# EasyEDA Pro project ProProject_IMUSensorNodes202312.epro, board 6_6_拼板20240123（带编号）
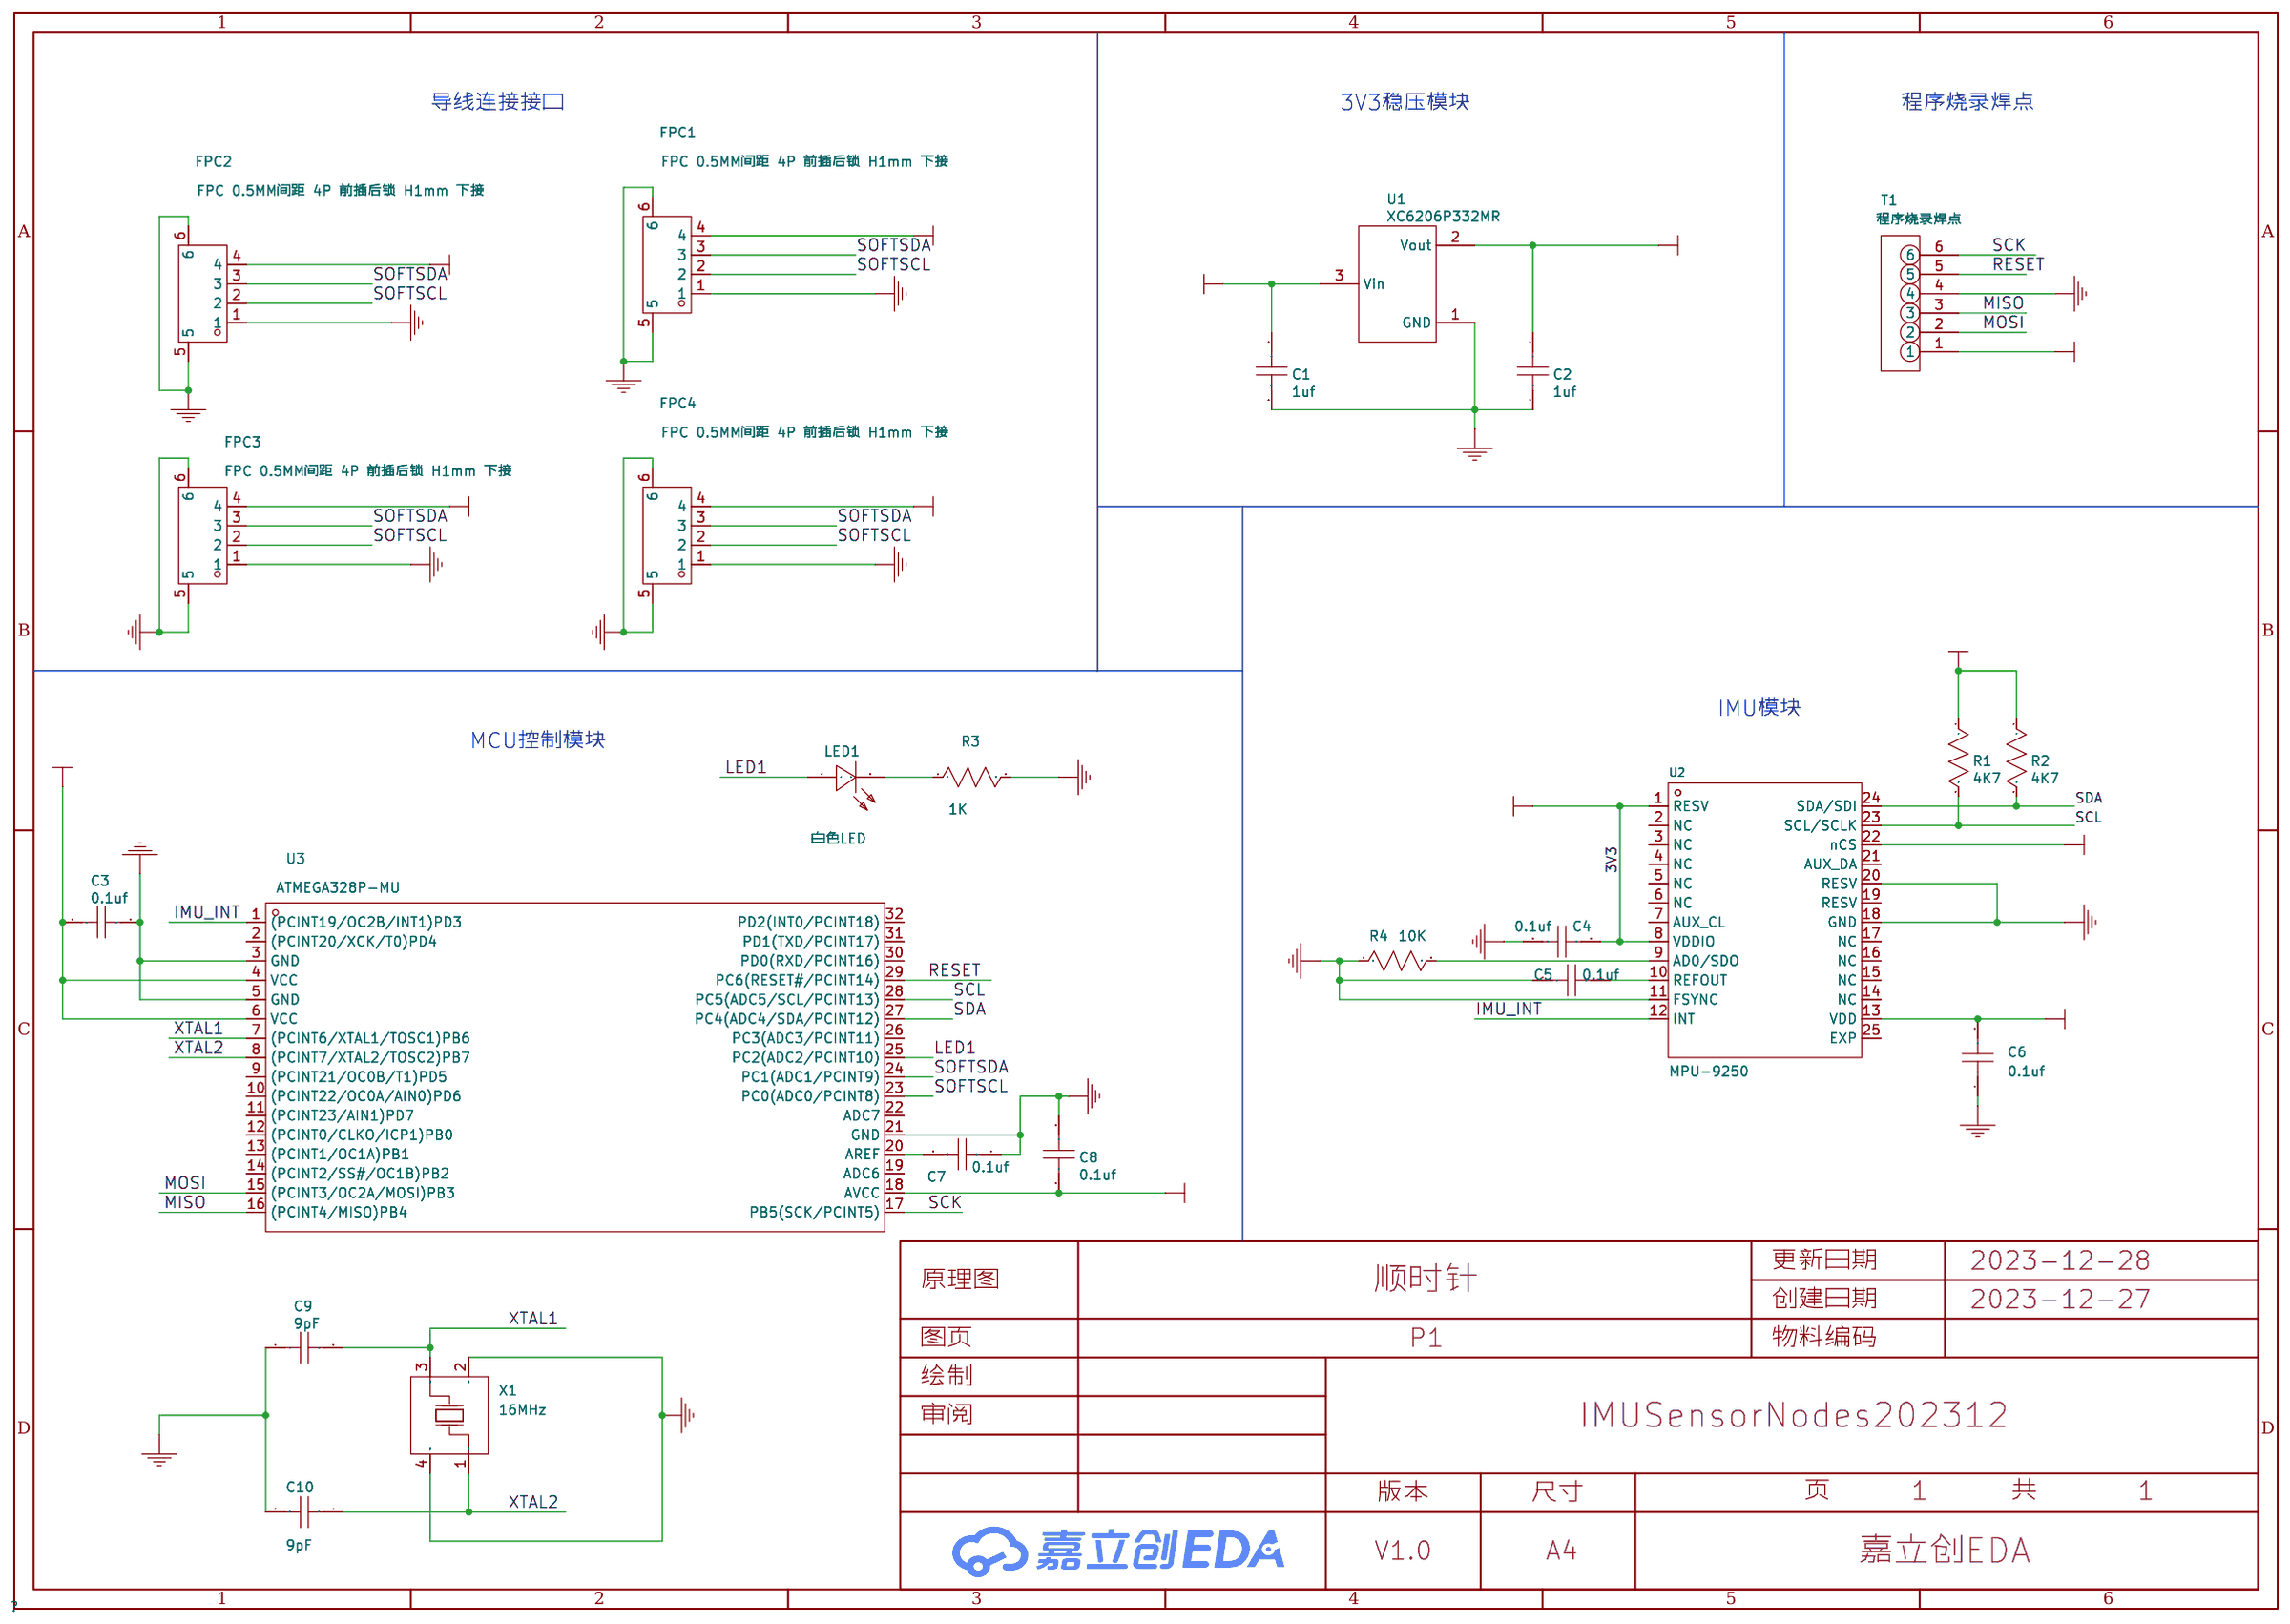
[diagram p0: schematic sheet]

Outline 80.29 x 80.59 mm; copper layers: Top Layer, Bottom Layer. Coordinates in mm from the lower left corner of the outline.
Outline path: 0,78.25 0,70.91 arc(0.68,69.26) 2.33,68.58 9.67,68.58 arc(11.32,69.26) 12,70.91 12,78.25 arc(11.32,79.9) 9.67,80.58 2.33,80.58 arc(0.68,79.9) 0,78.25 ; 0,64.53 0,57.19 arc(0.68,55.55) 2.33,54.86 9.67,54.86 arc(11.32,55.55) 12,57.19 12,64.53 arc(11.32,66.18) 9.67,66.86 2.33,66.86 arc(0.68,66.18) 0,64.53 ; 0,50.82 0,43.48 arc(0.68,41.83) 2.33,41.15 9.67,41.15 arc(11.32,41.83) 12,43.48 12,50.82 arc(11.32,52.46) 9.67,53.15 2.33,53.15 arc(0.68,52.46) 0,50.82 ; 0,37.1 0,29.76 arc(0.68,28.11) 2.33,27.43 9.67,27.43 arc(11.32,28.11) 12,29.76 12,37.1 arc(11.32,38.75) 9.67,39.43 2.33,39.43 arc(0.68,38.75) 0,37.1 ; 0,23.38 0,16.05 arc(0.68,14.4) 2.33,13.72 9.67,13.72 arc(11.32,14.4) 12,16.05 12,23.38 arc(11.32,25.03) 9.67,25.71 2.33,25.71 arc(0.68,25.03) 0,23.38 ; 0,9.67 0,2.33 arc(0.68,0.68) 2.33,0 9.67,0 arc(11.32,0.68) 12,2.33 12,9.67 arc(11.32,11.32) 9.67,12 2.33,12 arc(0.68,11.32) 0,9.67 ; 13.69,78.26 arc(14.37,79.91) 16.02,80.59 23.35,80.59 arc(25,79.91) 25.69,78.26 25.69,70.92 arc(25,69.28) 23.35,68.59 16.01,68.59 16.02,68.59 arc(14.37,69.28) 13.69,70.93 13.69,78.26 ; 13.69,64.55 arc(14.37,66.19) 16.02,66.88 23.35,66.88 arc(25,66.19) 25.69,64.54 25.69,57.21 arc(25,55.56) 23.35,54.88 16.01,54.88 16.02,54.88 arc(14.37,55.56) 13.69,57.21 13.69,64.55 ; 13.69,50.83 arc(14.37,52.48) 16.02,53.16 23.35,53.16 arc(25,52.48) 25.69,50.83 25.69,43.49 arc(25,41.84) 23.35,41.16 16.01,41.16 16.02,41.16 arc(14.37,41.84) 13.69,43.49 13.69,50.83 ; 13.69,37.11 arc(14.37,38.76) 16.02,39.44 23.35,39.44 arc(25,38.76) 25.69,37.11 25.69,29.78 arc(25,28.13) 23.35,27.45 16.01,27.44 16.02,27.45 arc(14.37,28.13) 13.69,29.78 13.69,37.11 ; 13.69,23.4 arc(14.37,25.04) 16.02,25.73 23.35,25.73 arc(25,25.04) 25.69,23.39 25.69,16.06 arc(25,14.41) 23.35,13.73 16.01,13.73 16.02,13.73 arc(14.37,14.41) 13.69,16.06 13.69,23.4 ; 13.69,9.68 arc(14.37,11.33) 16.02,12.01 23.35,12.01 arc(25,11.33) 25.69,9.68 25.69,2.34 arc(25,0.7) 23.35,0.01 16.01,0.01 16.02,0.01 arc(14.37,0.7) 13.69,2.35 13.69,9.68 ; 27.31,78.25 27.31,70.91 arc(27.99,69.26) 29.64,68.58 36.97,68.58 arc(38.62,69.26) 39.31,70.91 39.31,78.25 arc(38.62,79.9) 36.97,80.58 29.64,80.58 arc(27.99,79.9) 27.31,78.25 ; 27.31,64.53 27.31,57.19 arc(27.99,55.55) 29.64,54.86 36.97,54.86 arc(38.62,55.55) 39.31,57.19 39.31,64.53 arc(38.62,66.18) 36.97,66.86 29.64,66.86 arc(27.99,66.18) 27.31,64.53 ; 27.31,50.82 27.31,43.48 arc(27.99,41.83) 29.64,41.15 36.97,41.15 arc(38.62,41.83) 39.31,43.48 39.31,50.82 arc(38.62,52.46) 36.97,53.15 29.64,53.15 arc(27.99,52.46) 27.31,50.82 ; 27.31,37.1 27.31,29.76 arc(27.99,28.11) 29.64,27.43 36.97,27.43 arc(38.62,28.11) 39.31,29.76 39.31,37.1 arc(38.62,38.75) 36.97,39.43 29.64,39.43 arc(27.99,38.75) 27.31,37.1 ; 27.31,23.38 27.31,16.05 arc(27.99,14.4) 29.64,13.72 36.97,13.72 arc(38.62,14.4) 39.31,16.05 39.31,23.38 arc(38.62,25.03) 36.97,25.71 29.64,25.71 arc(27.99,25.03) 27.31,23.38 ; 27.31,9.67 27.31,2.33 arc(27.99,0.68) 29.64,0 36.97,0 arc(38.62,0.68) 39.31,2.33 39.31,9.67 arc(38.62,11.32) 36.97,12 29.64,12 arc(27.99,11.32) 27.31,9.67 ; 40.99,78.26 arc(41.67,79.91) 43.32,80.59 50.66,80.59 arc(52.31,79.91) 52.99,78.26 52.99,70.92 arc(52.31,69.28) 50.66,68.59 43.31,68.59 43.32,68.59 arc(41.67,69.28) 40.99,70.93 40.99,78.26 ; 40.99,64.55 arc(41.67,66.19) 43.32,66.88 50.66,66.88 arc(52.31,66.19) 52.99,64.54 52.99,57.21 arc(52.31,55.56) 50.66,54.88 43.31,54.88 43.32,54.88 arc(41.67,55.56) 40.99,57.21 40.99,64.55 ; 40.99,50.83 arc(41.67,52.48) 43.32,53.16 50.66,53.16 arc(52.31,52.48) 52.99,50.83 52.99,43.49 arc(52.31,41.84) 50.66,41.16 43.31,41.16 43.32,41.16 arc(41.67,41.84) 40.99,43.49 40.99,50.83 ; 40.99,37.11 arc(41.67,38.76) 43.32,39.44 50.66,39.44 arc(52.31,38.76) 52.99,37.11 52.99,29.78 arc(52.31,28.13) 50.66,27.45 43.31,27.44 43.32,27.45 arc(41.67,28.13) 40.99,29.78 40.99,37.11 ; 40.99,23.4 arc(41.67,25.04) 43.32,25.73 50.66,25.73 arc(52.31,25.04) 52.99,23.39 52.99,16.06 arc(52.31,14.41) 50.66,13.73 43.31,13.73 43.32,13.73 arc(41.67,14.41) 40.99,16.06 40.99,23.4 ; 40.99,9.68 arc(41.67,11.33) 43.32,12.01 50.66,12.01 arc(52.31,11.33) 52.99,9.68 52.99,2.34 arc(52.31,0.7) 50.66,0.01 43.31,0.01 43.32,0.01 arc(41.67,0.7) 40.99,2.35 40.99,9.68 ; 54.61,78.25 54.61,70.91 arc(55.29,69.26) 56.94,68.58 64.28,68.58 arc(65.93,69.26) 66.61,70.91 66.61,78.25 arc(65.93,79.9) 64.28,80.58 56.94,80.58 arc(55.29,79.9) 54.61,78.25 ; 54.61,64.53 54.61,57.19 arc(55.29,55.55) 56.94,54.86 64.28,54.86 arc(65.93,55.55) 66.61,57.19 66.61,64.53 arc(65.93,66.18) 64.28,66.86 56.94,66.86 arc(55.29,66.18) 54.61,64.53 ; 54.61,50.82 54.61,43.48 arc(55.29,41.83) 56.94,41.15 64.28,41.15 arc(65.93,41.83) 66.61,43.48 66.61,50.82 arc(65.93,52.46) 64.28,53.15 56.94,53.15 arc(55.29,52.46) 54.61,50.82 ; 54.61,37.1 54.61,29.76 arc(55.29,28.11) 56.94,27.43 64.28,27.43 arc(65.93,28.11) 66.61,29.76 66.61,37.1 arc(65.93,38.75) 64.28,39.43 56.94,39.43 arc(55.29,38.75) 54.61,37.1 ; 54.61,23.38 54.61,16.05 arc(55.29,14.4) 56.94,13.72 64.28,13.72 arc(65.93,14.4) 66.61,16.05 66.61,23.38 arc(65.93,25.03) 64.28,25.71 56.94,25.71 arc(55.29,25.03) 54.61,23.38 ; 54.61,9.67 54.61,2.33 arc(55.29,0.68) 56.94,0 64.28,0 arc(65.93,0.68) 66.61,2.33 66.61,9.67 arc(65.93,11.32) 64.28,12 56.94,12 arc(55.29,11.32) 54.61,9.67 ; 68.3,78.26 arc(68.98,79.91) 70.63,80.59 77.96,80.59 arc(79.61,79.91) 80.29,78.26 80.29,70.92 arc(79.61,69.28) 77.96,68.59 70.62,68.59 70.63,68.59 arc(68.98,69.28) 68.3,70.93 68.3,78.26 ; 68.3,64.55 arc(68.98,66.19) 70.63,66.88 77.96,66.88 arc(79.61,66.19) 80.29,64.54 80.29,57.21 arc(79.61,55.56) 77.96,54.88 70.62,54.88 70.63,54.88 arc(68.98,55.56) 68.3,57.21 68.3,64.55 ; 68.3,50.83 arc(68.98,52.48) 70.63,53.16 77.96,53.16 arc(79.61,52.48) 80.29,50.83 80.29,43.49 arc(79.61,41.84) 77.96,41.16 70.62,41.16 70.63,41.16 arc(68.98,41.84) 68.3,43.49 68.3,50.83 ; 68.3,37.11 arc(68.98,38.76) 70.63,39.44 77.96,39.44 arc(79.61,38.76) 80.29,37.11 80.29,29.78 arc(79.61,28.13) 77.96,27.45 70.62,27.44 70.63,27.45 arc(68.98,28.13) 68.3,29.78 68.3,37.11 ; 68.3,23.4 arc(68.98,25.04) 70.63,25.73 77.96,25.73 arc(79.61,25.04) 80.29,23.39 80.29,16.06 arc(79.61,14.41) 77.96,13.73 70.62,13.73 70.63,13.73 arc(68.98,14.41) 68.3,16.06 68.3,23.4 ; 68.3,9.68 arc(68.98,11.33) 70.63,12.01 77.96,12.01 arc(79.61,11.33) 80.29,9.68 80.29,2.34 arc(79.61,0.7) 77.96,0.01 70.62,0.01 70.63,0.01 arc(68.98,0.7) 68.3,2.35 68.3,9.68
Stack: Top Layer 0.035mm / Dielectric1 1.51mm FR4 er 4.5 / Bottom Layer 0.035mm

## Design rules (mm)
template: 自定义配置
spacing copperThickness1oz (default): track to track 0.102, other pairs 0.152 to 0.3
spacing copperThickness2oz: track to track 0.203, other pairs 0.152 to 0.3
track width copperThickness1oz (default): min 0.127, default 0.254, max 2.54
track width copperThickness2oz: min 0.203, default 0.254, max 2.54
differential pair differentialPair (default): width min 0.127, default 0.254, max 2.54; gap min 0.152, default 0.152
via viaSize (default): diameter min 0.5, default 0.61, max 10; hole min 0.3, default 0.305, max 6.299
net GND uses copperRegion1

## Placement (name value [footprint] x y rotation side)
Designator  -  [fpc-0.5mm-4p-h1.0]  49.82 47.15 90 top
Designator#2  -  [fpc-0.5mm-4p-h1.0#2]  3.2 19.71 270 top
Designator#3  -  [fpc-0.5mm-4p-h1.0#2]  16.92 60.86 270 top
Designator#4  -  [fpc-0.5mm-4p-h1.0#2]  33.31 63.66 180 top
Designator#5  -  [fpc-0.5mm-4p-h1.0]  22.52 6 90 top
Designator#6  -  [fpc-0.5mm-4p-h1.0#2]  74.33 8.8 180 top
Designator#7  -  [fpc-0.5mm-4p-h1.0#3]  19.72 58.06 0 top
Designator#8  -  [fpc-0.5mm-4p-h1.0#3]  47.02 71.78 0 top
Designator#9  -  [fpc-0.5mm-4p-h1.0#2]  57.81 74.58 270 top
Designator#10  -  [fpc-0.5mm-4p-h1.0#3]  19.72 30.63 0 top
Designator#11  -  [fpc-0.5mm-4p-h1.0]  22.52 47.15 90 top
Designator#12  -  [fpc-0.5mm-4p-h1.0#2]  60.61 8.8 180 top
Designator#13  -  [fpc-0.5mm-4p-h1.0]  36.1 19.71 90 top
Designator#14  -  [fpc-0.5mm-4p-h1.0]  77.13 6 90 top
Designator#15  -  [fpc-0.5mm-4p-h1.0#2]  19.72 36.23 180 top
Designator#16  -  [fpc-0.5mm-4p-h1.0#3]  47.02 16.91 0 top
Designator#17  -  [fpc-0.5mm-4p-h1.0#2]  33.31 22.51 180 top
Designator#18  -  [fpc-0.5mm-4p-h1.0#2]  74.33 77.38 180 top
Designator#19  -  [fpc-0.5mm-4p-h1.0#2]  6 58.06 0 top
Designator#20  -  [fpc-0.5mm-4p-h1.0#2]  6 8.8 180 top
Designator#21  -  [邮票孔]  26.68 33.57 0 top
Designator#22  -  [邮票孔]  40.32 33.56 0 top
Designator#23  -  [邮票孔]  53.98 33.57 0 top
Designator#24  -  [邮票孔]  67.64 33.43 0 top
Designator#25  -  [邮票孔]  5.87 26.73 90 top
Designator#26  -  [邮票孔]  74.08 26.73 90 top
Designator#27  -  [邮票孔]  60.4 26.73 90 top
Designator#28  -  [邮票孔]  33.1 26.73 90 top
Designator#29  -  [邮票孔]  19.47 26.73 90 top
Designator#30  -  [邮票孔]  46.78 26.73 90 top
Designator#31  -  [邮票孔]  5.87 67.88 90 top
Designator#32  -  [邮票孔]  19.47 67.88 90 top
Designator#33  -  [邮票孔]  33.1 67.88 90 top
Designator#34  -  [邮票孔]  46.78 67.88 90 top
Designator#35  -  [邮票孔]  60.4 67.88 90 top
Designator#36  -  [邮票孔]  74.08 67.88 90 top
Designator#37  -  [邮票孔]  13.02 19.71 0 top
Designator#38  -  [邮票孔]  26.68 19.85 0 top
Designator#39  -  [邮票孔]  40.32 19.84 0 top
Designator#40  -  [邮票孔]  53.98 19.85 0 top
Designator#41  -  [邮票孔]  67.64 19.71 0 top
Designator#42  -  [邮票孔]  5.87 13.02 90 top
Designator#43  -  [邮票孔]  74.08 13.02 90 top
Designator#44  -  [邮票孔]  60.4 13.02 90 top
Designator#45  -  [邮票孔]  33.1 13.02 90 top
Designator#46  -  [邮票孔]  19.47 13.02 90 top
Designator#47  -  [邮票孔]  46.78 13.02 90 top
Designator#48  -  [邮票孔]  13.02 6 0 top
Designator#49  -  [邮票孔]  13.02 74.58 0 top
Designator#50  -  [邮票孔]  26.68 6.14 0 top
Designator#51  -  [邮票孔]  40.32 6.13 0 top
Designator#52  -  [邮票孔]  53.98 6.14 0 top
Designator#53  -  [邮票孔]  67.64 6 0 top
Designator#54  -  [邮票孔]  53.98 74.72 0 top
Designator#55  -  [邮票孔]  67.64 74.58 0 top
Designator#56  -  [邮票孔]  26.68 74.72 0 top
Designator#57  -  [邮票孔]  40.32 74.71 0 top
Designator#58  -  [邮票孔]  13.02 60.86 0 top
Designator#59  -  [邮票孔]  26.68 61 0 top
Designator#60  -  [邮票孔]  40.32 60.99 0 top
Designator#61  -  [邮票孔]  53.98 61 0 top
Designator#62  -  [邮票孔]  67.64 60.86 0 top
Designator#63  -  [邮票孔]  5.87 54.17 90 top
Designator#64  -  [邮票孔]  74.08 54.17 90 top
Designator#65  -  [邮票孔]  60.4 54.17 90 top
Designator#66  -  [邮票孔]  33.1 54.17 90 top
Designator#67  -  [邮票孔]  19.47 54.17 90 top
Designator#68  -  [邮票孔]  46.78 54.17 90 top
Designator#69  -  [邮票孔]  13.02 47.15 0 top
Designator#70  -  [邮票孔]  26.68 47.29 0 top
Designator#71  -  [邮票孔]  40.32 47.28 0 top
Designator#72  -  [邮票孔]  53.98 47.29 0 top
Designator#73  -  [邮票孔]  67.64 47.15 0 top
Designator#74  -  [邮票孔]  5.87 40.45 90 top
Designator#75  -  [邮票孔]  74.08 40.45 90 top
Designator#76  -  [邮票孔]  60.4 40.45 90 top
Designator#77  -  [邮票孔]  33.1 40.45 90 top
Designator#78  -  [邮票孔]  19.47 40.45 90 top
Designator#79  -  [邮票孔]  46.78 40.45 90 top
Designator#80  -  [邮票孔]  13.02 33.43 0 top
Designator#81  -  [fpc-0.5mm-4p-h1.0#2]  3.2 6 270 top
Designator#82  -  [fpc-0.5mm-4p-h1.0#2]  6 77.38 180 top
Designator#83  -  [fpc-0.5mm-4p-h1.0]  8.8 47.15 90 top
Designator#84  -  [fpc-0.5mm-4p-h1.0]  8.8 19.71 90 top
Designator#85  -  [fpc-0.5mm-4p-h1.0#3]  74.33 44.35 0 top
Designator#86  -  [fpc-0.5mm-4p-h1.0#2]  44.22 6 270 top
Designator#87  -  [fpc-0.5mm-4p-h1.0#2]  57.81 33.43 270 top
Designator#88  -  [fpc-0.5mm-4p-h1.0#3]  74.33 71.78 0 top
Designator#89  -  [fpc-0.5mm-4p-h1.0#2]  60.61 58.06 0 top
Designator#90  -  [fpc-0.5mm-4p-h1.0#2]  60.61 3.2 0 top
Designator#91  -  [fpc-0.5mm-4p-h1.0#2]  6 36.23 180 top
Designator#92  -  [fpc-0.5mm-4p-h1.0#2]  71.53 74.58 270 top
Designator#93  -  [fpc-0.5mm-4p-h1.0#2]  74.33 36.23 180 top
Designator#94  -  [fpc-0.5mm-4p-h1.0#2]  16.92 33.43 270 top
Designator#95  -  [fpc-0.5mm-4p-h1.0]  8.8 33.43 90 top
Designator#96  -  [fpc-0.5mm-4p-h1.0#3]  74.33 30.63 0 top
Designator#97  -  [fpc-0.5mm-4p-h1.0]  63.41 6 90 top
Designator#98  -  [fpc-0.5mm-4p-h1.0#2]  71.53 6 270 top
Designator#99  -  [fpc-0.5mm-4p-h1.0]  22.52 33.43 90 top
Designator#100  -  [fpc-0.5mm-4p-h1.0#2]  3.2 60.86 270 top
Designator#101  -  [fpc-0.5mm-4p-h1.0#3]  19.72 44.35 0 top
Designator#102  -  [fpc-0.5mm-4p-h1.0#2]  6 3.2 0 top
Designator#103  -  [fpc-0.5mm-4p-h1.0]  63.41 33.43 90 top
Designator#104  -  [fpc-0.5mm-4p-h1.0#2]  57.81 6 270 top
Designator#105  -  [fpc-0.5mm-4p-h1.0#3]  19.72 3.2 0 top
Designator#106  -  [fpc-0.5mm-4p-h1.0#2]  57.81 19.71 270 top
Designator#107  -  [fpc-0.5mm-4p-h1.0#3]  47.02 30.63 0 top
Designator#108  -  [fpc-0.5mm-4p-h1.0#2]  60.61 16.91 0 top
Designator#109  -  [fpc-0.5mm-4p-h1.0]  63.41 47.15 90 top
Designator#110  -  [CRYSTAL-SMD_4P-L1.6-W1.2-BL]  64.17 23.91 90 top
Designator#111  -  [CRYSTAL-SMD_4P-L1.6-W1.2-BL]  77.88 23.91 90 top
Designator#112  -  [CRYSTAL-SMD_4P-L1.6-W1.2-BL]  9.56 37.62 90 top
Designator#113  -  [CRYSTAL-SMD_4P-L1.6-W1.2-BL]  23.27 37.62 90 top
Designator#114  -  [CRYSTAL-SMD_4P-L1.6-W1.2-BL]  36.86 37.62 90 top
Designator#115  -  [CRYSTAL-SMD_4P-L1.6-W1.2-BL]  50.58 37.62 90 top
Designator#116  -  [CRYSTAL-SMD_4P-L1.6-W1.2-BL]  64.17 37.62 90 top
Designator#117  -  [CRYSTAL-SMD_4P-L1.6-W1.2-BL]  77.88 37.62 90 top
Designator#118  -  [CRYSTAL-SMD_4P-L1.6-W1.2-BL]  77.88 78.77 90 top
Designator#119  -  [CRYSTAL-SMD_4P-L1.6-W1.2-BL]  9.56 23.91 90 top
Designator#120  -  [CRYSTAL-SMD_4P-L1.6-W1.2-BL]  23.27 23.91 90 top
Designator#121  -  [CRYSTAL-SMD_4P-L1.6-W1.2-BL]  36.86 23.91 90 top
Designator#122  -  [CRYSTAL-SMD_4P-L1.6-W1.2-BL]  50.58 23.91 90 top
Designator#123  -  [CRYSTAL-SMD_4P-L1.6-W1.2-BL]  9.56 10.19 90 top
Designator#124  -  [CRYSTAL-SMD_4P-L1.6-W1.2-BL]  23.27 10.19 90 top
Designator#125  -  [CRYSTAL-SMD_4P-L1.6-W1.2-BL]  36.86 10.19 90 top
Designator#126  -  [CRYSTAL-SMD_4P-L1.6-W1.2-BL]  50.58 10.19 90 top
Designator#127  -  [CRYSTAL-SMD_4P-L1.6-W1.2-BL]  64.17 10.19 90 top
Designator#128  -  [CRYSTAL-SMD_4P-L1.6-W1.2-BL]  77.88 10.19 90 top
Designator#129  -  [CRYSTAL-SMD_4P-L1.6-W1.2-BL]  9.56 78.77 90 top
Designator#130  -  [CRYSTAL-SMD_4P-L1.6-W1.2-BL]  64.17 78.77 90 top
Designator#131  -  [CRYSTAL-SMD_4P-L1.6-W1.2-BL]  23.27 78.77 90 top
Designator#132  -  [CRYSTAL-SMD_4P-L1.6-W1.2-BL]  36.86 78.77 90 top
Designator#133  -  [CRYSTAL-SMD_4P-L1.6-W1.2-BL]  50.58 78.77 90 top
Designator#134  -  [CRYSTAL-SMD_4P-L1.6-W1.2-BL]  9.56 65.05 90 top
Designator#135  -  [CRYSTAL-SMD_4P-L1.6-W1.2-BL]  23.27 65.05 90 top
Designator#136  -  [CRYSTAL-SMD_4P-L1.6-W1.2-BL]  36.86 65.05 90 top
Designator#137  -  [CRYSTAL-SMD_4P-L1.6-W1.2-BL]  50.58 65.05 90 top
Designator#138  -  [CRYSTAL-SMD_4P-L1.6-W1.2-BL]  64.17 65.05 90 top
Designator#139  -  [CRYSTAL-SMD_4P-L1.6-W1.2-BL]  77.88 65.05 90 top
Designator#140  -  [CRYSTAL-SMD_4P-L1.6-W1.2-BL]  9.56 51.34 90 top
Designator#141  -  [CRYSTAL-SMD_4P-L1.6-W1.2-BL]  23.27 51.34 90 top
Designator#142  -  [CRYSTAL-SMD_4P-L1.6-W1.2-BL]  36.86 51.34 90 top
Designator#143  -  [CRYSTAL-SMD_4P-L1.6-W1.2-BL]  50.58 51.34 90 top
Designator#144  -  [CRYSTAL-SMD_4P-L1.6-W1.2-BL]  64.17 51.34 90 top
Designator#145  -  [CRYSTAL-SMD_4P-L1.6-W1.2-BL]  77.88 51.34 90 top
Designator#146  -  [fpc-0.5mm-4p-h1.0]  36.1 47.15 90 top
Designator#147  -  [fpc-0.5mm-4p-h1.0#2]  60.61 36.23 180 top
Designator#148  -  [fpc-0.5mm-4p-h1.0]  49.82 19.71 90 top
Designator#149  -  [fpc-0.5mm-4p-h1.0#2]  33.31 3.2 0 top
Designator#150  -  [fpc-0.5mm-4p-h1.0#2]  71.53 33.43 270 top
Designator#151  -  [fpc-0.5mm-4p-h1.0]  22.52 74.58 90 top
Designator#152  -  [fpc-0.5mm-4p-h1.0#2]  6 63.66 180 top
Designator#153  -  [fpc-0.5mm-4p-h1.0#2]  33.31 71.78 0 top
Designator#154  -  [fpc-0.5mm-4p-h1.0#2]  60.61 44.35 0 top
Designator#155  -  [fpc-0.5mm-4p-h1.0]  8.8 60.86 90 top
Designator#156  -  [fpc-0.5mm-4p-h1.0#2]  16.92 6 270 top
Designator#157  -  [fpc-0.5mm-4p-h1.0]  77.13 19.71 90 top
Designator#158  -  [fpc-0.5mm-4p-h1.0#2]  30.5 33.43 270 top
Designator#159  -  [fpc-0.5mm-4p-h1.0]  49.82 6 90 top
Designator#160  -  [fpc-0.5mm-4p-h1.0]  36.1 33.43 90 top
Designator#161  -  [fpc-0.5mm-4p-h1.0#3]  19.72 16.91 0 top
Designator#162  -  [fpc-0.5mm-4p-h1.0#2]  60.61 77.38 180 top
Designator#163  -  [fpc-0.5mm-4p-h1.0#3]  47.02 3.2 0 top
Designator#164  -  [fpc-0.5mm-4p-h1.0#2]  57.81 47.15 270 top
Designator#165  -  [fpc-0.5mm-4p-h1.0]  63.41 74.58 90 top
Designator#166  -  [fpc-0.5mm-4p-h1.0]  49.82 74.58 90 top
Designator#167  -  [fpc-0.5mm-4p-h1.0#2]  30.5 60.86 270 top
Designator#168  -  [fpc-0.5mm-4p-h1.0#2]  30.5 6 270 top
Designator#169  -  [fpc-0.5mm-4p-h1.0]  22.52 19.71 90 top
Designator#170  -  [fpc-0.5mm-4p-h1.0]  63.41 19.71 90 top
Designator#171  -  [fpc-0.5mm-4p-h1.0]  36.1 60.86 90 top
Designator#172  -  [fpc-0.5mm-4p-h1.0#2]  6 16.91 0 top
Designator#173  -  [fpc-0.5mm-4p-h1.0#2]  30.5 47.15 270 top
Designator#174  -  [fpc-0.5mm-4p-h1.0#2]  33.31 16.91 0 top
Designator#175  -  [fpc-0.5mm-4p-h1.0]  49.82 33.43 90 top
Designator#176  -  [fpc-0.5mm-4p-h1.0#2]  60.61 63.66 180 top
Designator#177  -  [fpc-0.5mm-4p-h1.0#2]  6 71.78 0 top
Designator#178  -  [R0201]  14.51 30.38 270 top
Designator#179  -  [R0201]  28.1 30.38 270 top
Designator#180  -  [R0201]  41.81 30.38 270 top
Designator#181  -  [R0201]  55.4 30.38 270 top
Designator#182  -  [R0201]  69.12 30.38 270 top
Designator#183  -  [R0201]  69.12 71.53 270 top
Designator#184  -  [R0201]  0.79 16.67 270 top
Designator#185  -  [R0201]  14.51 16.67 270 top
Designator#186  -  [R0201]  28.1 16.67 270 top
Designator#187  -  [R0201]  41.81 16.67 270 top
Designator#188  -  [R0201]  55.4 16.67 270 top
Designator#189  -  [R0201]  69.12 16.67 270 top
Designator#190  -  [R0201]  0.79 2.95 270 top
Designator#191  -  [R0201]  14.51 2.95 270 top
Designator#192  -  [R0201]  28.1 2.95 270 top
Designator#193  -  [R0201]  41.81 2.95 270 top
Designator#194  -  [R0201]  55.4 2.95 270 top
Designator#195  -  [R0201]  69.12 2.95 270 top
Designator#196  -  [R0201]  0.79 71.53 270 top
Designator#197  -  [R0201]  55.4 71.53 270 top
Designator#198  -  [R0201]  14.51 71.53 270 top
Designator#199  -  [R0201]  28.1 71.53 270 top
Designator#200  -  [R0201]  41.81 71.53 270 top
Designator#201  -  [R0201]  0.79 57.81 270 top
Designator#202  -  [R0201]  14.51 57.81 270 top
Designator#203  -  [R0201]  28.1 57.81 270 top
Designator#204  -  [R0201]  41.81 57.81 270 top
Designator#205  -  [R0201]  55.4 57.81 270 top
Designator#206  -  [R0201]  69.12 57.81 270 top
Designator#207  -  [R0201]  0.79 44.1 270 top
Designator#208  -  [R0201]  14.51 44.1 270 top
Designator#209  -  [R0201]  28.1 44.1 270 top
Designator#210  -  [R0201]  41.81 44.1 270 top
Designator#211  -  [R0201]  55.4 44.1 270 top
Designator#212  -  [R0201]  69.12 44.1 270 top
Designator#213  -  [R0201]  0.79 30.38 270 top
Designator#214  -  [fpc-0.5mm-4p-h1.0#2]  19.72 49.95 180 top
Designator#215  -  [fpc-0.5mm-4p-h1.0]  77.13 47.15 90 top
Designator#216  -  [fpc-0.5mm-4p-h1.0#2]  60.61 30.63 0 top
Designator#217  -  [fpc-0.5mm-4p-h1.0#2]  71.53 19.71 270 top
Designator#218  -  [fpc-0.5mm-4p-h1.0#2]  47.02 36.23 180 top
Designator#219  -  [fpc-0.5mm-4p-h1.0#2]  44.22 33.43 270 top
Designator#220  -  [fpc-0.5mm-4p-h1.0#2]  30.5 74.58 270 top
Designator#221  -  [fpc-0.5mm-4p-h1.0#2]  47.02 22.51 180 top
Designator#222  -  [fpc-0.5mm-4p-h1.0#3]  74.33 16.91 0 top
Designator#223  -  [fpc-0.5mm-4p-h1.0#3]  74.33 3.2 0 top
Designator#224  -  [fpc-0.5mm-4p-h1.0#3]  47.02 44.35 0 top
Designator#225  -  [fpc-0.5mm-4p-h1.0#2]  19.72 63.66 180 top
Designator#226  -  [fpc-0.5mm-4p-h1.0#2]  33.31 36.23 180 top
Designator#227  -  [fpc-0.5mm-4p-h1.0#2]  60.61 71.78 0 top
Designator#228  -  [fpc-0.5mm-4p-h1.0#2]  6 49.95 180 top
Designator#229  -  [fpc-0.5mm-4p-h1.0#2]  3.2 33.43 270 top
Designator#230  -  [fpc-0.5mm-4p-h1.0#2]  47.02 49.95 180 top
Designator#231  -  [fpc-0.5mm-4p-h1.0#2]  47.02 8.8 180 top
Designator#232  -  [fpc-0.5mm-4p-h1.0]  8.8 74.58 90 top
Designator#233  -  [fpc-0.5mm-4p-h1.0#2]  44.22 47.15 270 top
Designator#234  -  [fpc-0.5mm-4p-h1.0#2]  44.22 60.86 270 top
Designator#235  -  [fpc-0.5mm-4p-h1.0#2]  60.61 22.51 180 top
Designator#236  -  [fpc-0.5mm-4p-h1.0#3]  74.33 58.06 0 top
Designator#237  -  [fpc-0.5mm-4p-h1.0#2]  71.53 60.86 270 top
Designator#238  -  [fpc-0.5mm-4p-h1.0#2]  74.33 22.51 180 top
Designator#239  -  [fpc-0.5mm-4p-h1.0#2]  74.33 63.66 180 top
Designator#240  -  [fpc-0.5mm-4p-h1.0#3]  47.02 58.06 0 top
Designator#241  -  [fpc-0.5mm-4p-h1.0#2]  57.81 60.86 270 top
Designator#242  -  [fpc-0.5mm-4p-h1.0#2]  6 30.63 0 top
Designator#243  -  [fpc-0.5mm-4p-h1.0]  77.13 33.43 90 top
Designator#244  -  [fpc-0.5mm-4p-h1.0]  36.1 6 90 top
Designator#245  -  [fpc-0.5mm-4p-h1.0#2]  33.31 30.63 0 top
Designator#246  -  [LED0402]  15.4 30.25 90 top
Designator#247  -  [LED0402]  28.99 30.25 90 top
Designator#248  -  [LED0402]  42.7 30.25 90 top
Designator#249  -  [LED0402]  56.29 30.25 90 top
Designator#250  -  [LED0402]  70.01 30.25 90 top
Designator#251  -  [LED0402]  70.01 71.4 90 top
Designator#252  -  [LED0402]  1.68 16.54 90 top
Designator#253  -  [LED0402]  15.4 16.54 90 top
Designator#254  -  [LED0402]  28.99 16.54 90 top
Designator#255  -  [LED0402]  42.7 16.54 90 top
Designator#256  -  [LED0402]  56.29 16.54 90 top
Designator#257  -  [LED0402]  70.01 16.54 90 top
Designator#258  -  [LED0402]  1.68 2.82 90 top
Designator#259  -  [LED0402]  15.4 2.82 90 top
Designator#260  -  [LED0402]  28.99 2.82 90 top
Designator#261  -  [LED0402]  42.7 2.82 90 top
Designator#262  -  [LED0402]  56.29 2.82 90 top
Designator#263  -  [LED0402]  70.01 2.82 90 top
Designator#264  -  [LED0402]  1.68 71.4 90 top
Designator#265  -  [LED0402]  56.29 71.4 90 top
Designator#266  -  [LED0402]  15.4 71.4 90 top
Designator#267  -  [LED0402]  28.99 71.4 90 top
Designator#268  -  [LED0402]  42.7 71.4 90 top
Designator#269  -  [LED0402]  1.68 57.69 90 top
Designator#270  -  [LED0402]  15.4 57.69 90 top
Designator#271  -  [LED0402]  28.99 57.69 90 top
Designator#272  -  [LED0402]  42.7 57.69 90 top
Designator#273  -  [LED0402]  56.29 57.69 90 top
Designator#274  -  [LED0402]  70.01 57.69 90 top
Designator#275  -  [LED0402]  1.68 43.97 90 top
Designator#276  -  [LED0402]  15.4 43.97 90 top
Designator#277  -  [LED0402]  28.99 43.97 90 top
Designator#278  -  [LED0402]  42.7 43.97 90 top
Designator#279  -  [LED0402]  56.29 43.97 90 top
Designator#280  -  [LED0402]  70.01 43.97 90 top
Designator#281  -  [LED0402]  1.68 30.25 90 top
Designator#282  -  [fpc-0.5mm-4p-h1.0#2]  3.2 47.15 270 top
Designator#283  -  [fpc-0.5mm-4p-h1.0#2]  16.92 47.15 270 top
Designator#284  -  [fpc-0.5mm-4p-h1.0#2]  30.5 19.71 270 top
Designator#285  -  [fpc-0.5mm-4p-h1.0#2]  33.31 44.35 0 top
Designator#286  -  [fpc-0.5mm-4p-h1.0#2]  6 22.51 180 top
Designator#287  -  [fpc-0.5mm-4p-h1.0]  8.8 6 90 top
Designator#288  -  [fpc-0.5mm-4p-h1.0]  36.1 74.58 90 top
Designator#289  -  [fpc-0.5mm-4p-h1.0#2]  3.2 74.58 270 top
Designator#290  -  [fpc-0.5mm-4p-h1.0#2]  16.92 74.58 270 top
Designator#291  -  [fpc-0.5mm-4p-h1.0#2]  47.02 77.38 180 top
Designator#292  -  [fpc-0.5mm-4p-h1.0#2]  71.53 47.15 270 top
Designator#293  -  [fpc-0.5mm-4p-h1.0#3]  19.72 71.78 0 top
Designator#294  -  [fpc-0.5mm-4p-h1.0#2]  44.22 74.58 270 top
Designator#295  -  [fpc-0.5mm-4p-h1.0#2]  6 44.35 0 top
Designator#296  -  [fpc-0.5mm-4p-h1.0#2]  33.31 77.38 180 top
Designator#297  -  [fpc-0.5mm-4p-h1.0]  49.82 60.86 90 top
Designator#298  -  [fpc-0.5mm-4p-h1.0#2]  16.92 19.71 270 top
Designator#299  -  [fpc-0.5mm-4p-h1.0]  77.13 74.58 90 top
Designator#300  -  [fpc-0.5mm-4p-h1.0]  22.52 60.86 90 top
Designator#301  -  [fpc-0.5mm-4p-h1.0#2]  19.72 8.8 180 top
Designator#302  -  [fpc-0.5mm-4p-h1.0#2]  19.72 77.38 180 top
Designator#303  -  [fpc-0.5mm-4p-h1.0#2]  19.72 22.51 180 top
Designator#304  -  [fpc-0.5mm-4p-h1.0#2]  33.31 49.95 180 top
Designator#305  -  [fpc-0.5mm-4p-h1.0]  63.41 60.86 90 top
Designator#306  -  [fpc-0.5mm-4p-h1.0#2]  33.31 58.06 0 top
Designator#307  -  [fpc-0.5mm-4p-h1.0#2]  60.61 49.95 180 top
Designator#308  -  [fpc-0.5mm-4p-h1.0]  77.13 60.86 90 top
Designator#309  -  [fpc-0.5mm-4p-h1.0#2]  47.02 63.66 180 top
Designator#310  -  [fpc-0.5mm-4p-h1.0#2]  33.31 8.8 180 top
Designator#311  -  [fpc-0.5mm-4p-h1.0#2]  74.33 49.95 180 top
Designator#312  -  [fpc-0.5mm-4p-h1.0#2]  44.22 19.71 270 top
Designator#313  -  [vqfn-32_l5.0-w5.0-p0.50-tl-ep3.1]  31.65 72.55 270 bottom
Designator#314  -  [qfn-24_l3.0-w3.0-p0.40-bl-ep]  45.62 64.29 0 bottom
Designator#315  -  [test]  77.73 31.83 270 bottom
Designator#316  -  [test]  77.73 59.26 270 bottom
Designator#317  -  [qfn-24_l3.0-w3.0-p0.40-bl-ep#2]  4.6 36.86 0 bottom
Designator#318  -  [qfn-24_l3.0-w3.0-p0.40-bl-ep#2]  4.6 23.14 0 bottom
Designator#319  -  [qfn-24_l3.0-w3.0-p0.40-bl-ep#2]  31.91 50.58 0 bottom
Designator#320  -  [test]  50.42 45.54 270 bottom
Designator#321  -  [vqfn-32_l5.0-w5.0-p0.50-tl-ep3.1]  31.65 17.68 270 bottom
Designator#322  -  [vqfn-32_l5.0-w5.0-p0.50-tl-ep3.1#2]  45.37 45.11 270 bottom
Designator#323  -  [qfn-24_l3.0-w3.0-p0.40-bl-ep]  18.32 9.43 0 bottom
Designator#324  -  [vqfn-32_l5.0-w5.0-p0.50-tl-ep3.1#2]  45.37 58.83 270 bottom
Designator#325  -  [vqfn-32_l5.0-w5.0-p0.50-tl-ep3.1]  4.35 72.55 270 bottom
Designator#326  -  [qfn-24_l3.0-w3.0-p0.40-bl-ep]  45.62 9.43 0 bottom
Designator#327  -  [test]  23.12 59.26 270 bottom
Designator#328  -  [R0201]  75.6 23.78 180 bottom
Designator#329  -  [R0201]  15.78 38.26 0 bottom
Designator#330  -  [R0201]  15.78 37.24 0 bottom
Designator#331  -  [R0201]  20.99 37.49 180 bottom
Designator#332  -  [R0201]  29.11 38.38 0 bottom
Designator#333  -  [R0201]  29.11 37.24 0 bottom
Designator#334  -  [R0201]  34.7 37.49 180 bottom
Designator#335  -  [R0201]  43.08 38.26 0 bottom
Designator#336  -  [R0201]  43.08 37.24 0 bottom
Designator#337  -  [R0201]  48.29 37.49 180 bottom
Designator#338  -  [R0201]  56.42 38.38 0 bottom
Designator#339  -  [R0201]  56.42 37.24 0 bottom
Designator#340  -  [R0201]  62.01 37.49 180 bottom
Designator#341  -  [R0201]  70.39 38.26 0 bottom
Designator#342  -  [R0201]  70.39 37.24 0 bottom
Designator#343  -  [R0201]  75.6 37.49 180 bottom
Designator#344  -  [R0201]  70.39 79.4 0 bottom
Designator#345  -  [R0201]  70.39 78.39 0 bottom
Designator#346  -  [R0201]  75.6 78.64 180 bottom
Designator#347  -  [R0201]  1.81 24.67 0 bottom
Designator#348  -  [R0201]  1.81 23.52 0 bottom
Designator#349  -  [R0201]  7.4 23.78 180 bottom
Designator#350  -  [R0201]  15.78 24.54 0 bottom
Designator#351  -  [R0201]  15.78 23.52 0 bottom
Designator#352  -  [R0201]  20.99 23.78 180 bottom
Designator#353  -  [R0201]  29.11 24.67 0 bottom
Designator#354  -  [R0201]  29.11 23.52 0 bottom
Designator#355  -  [R0201]  34.7 23.78 180 bottom
Designator#356  -  [R0201]  43.08 24.54 0 bottom
Designator#357  -  [R0201]  43.08 23.52 0 bottom
Designator#358  -  [R0201]  48.29 23.78 180 bottom
Designator#359  -  [R0201]  56.42 24.67 0 bottom
Designator#360  -  [R0201]  56.42 23.52 0 bottom
Designator#361  -  [R0201]  62.01 23.78 180 bottom
Designator#362  -  [R0201]  70.39 24.54 0 bottom
Designator#363  -  [R0201]  70.39 23.52 0 bottom
Designator#364  -  [R0201]  1.81 10.95 0 bottom
Designator#365  -  [R0201]  1.81 9.81 0 bottom
Designator#366  -  [R0201]  7.4 10.06 180 bottom
Designator#367  -  [R0201]  15.78 10.82 0 bottom
Designator#368  -  [R0201]  15.78 9.81 0 bottom
Designator#369  -  [R0201]  20.99 10.06 180 bottom
Designator#370  -  [R0201]  29.11 10.95 0 bottom
Designator#371  -  [R0201]  29.11 9.81 0 bottom
Designator#372  -  [R0201]  34.7 10.06 180 bottom
Designator#373  -  [R0201]  43.08 10.82 0 bottom
Designator#374  -  [R0201]  43.08 9.81 0 bottom
Designator#375  -  [R0201]  48.29 10.06 180 bottom
Designator#376  -  [R0201]  56.42 10.95 0 bottom
Designator#377  -  [R0201]  56.42 9.81 0 bottom
Designator#378  -  [R0201]  62.01 10.06 180 bottom
Designator#379  -  [R0201]  70.39 10.82 0 bottom
Designator#380  -  [R0201]  70.39 9.81 0 bottom
Designator#381  -  [R0201]  75.6 10.06 180 bottom
Designator#382  -  [R0201]  1.81 79.53 0 bottom
Designator#383  -  [R0201]  1.81 78.39 0 bottom
Designator#384  -  [R0201]  7.4 78.64 180 bottom
Designator#385  -  [R0201]  56.42 79.53 0 bottom
Designator#386  -  [R0201]  56.42 78.39 0 bottom
Designator#387  -  [R0201]  62.01 78.64 180 bottom
Designator#388  -  [R0201]  15.78 79.4 0 bottom
Designator#389  -  [R0201]  15.78 78.39 0 bottom
Designator#390  -  [R0201]  20.99 78.64 180 bottom
Designator#391  -  [R0201]  29.11 79.53 0 bottom
Designator#392  -  [R0201]  29.11 78.39 0 bottom
Designator#393  -  [R0201]  34.7 78.64 180 bottom
Designator#394  -  [R0201]  43.08 79.4 0 bottom
Designator#395  -  [R0201]  43.08 78.39 0 bottom
Designator#396  -  [R0201]  48.29 78.64 180 bottom
Designator#397  -  [R0201]  1.81 65.81 0 bottom
Designator#398  -  [R0201]  1.81 64.67 0 bottom
Designator#399  -  [R0201]  7.4 64.93 180 bottom
Designator#400  -  [R0201]  15.78 65.69 0 bottom
Designator#401  -  [R0201]  15.78 64.67 0 bottom
Designator#402  -  [R0201]  20.99 64.93 180 bottom
Designator#403  -  [R0201]  29.11 65.81 0 bottom
Designator#404  -  [R0201]  29.11 64.67 0 bottom
Designator#405  -  [R0201]  34.7 64.93 180 bottom
Designator#406  -  [R0201]  43.08 65.69 0 bottom
Designator#407  -  [R0201]  43.08 64.67 0 bottom
Designator#408  -  [R0201]  48.29 64.93 180 bottom
Designator#409  -  [R0201]  56.42 65.81 0 bottom
Designator#410  -  [R0201]  56.42 64.67 0 bottom
Designator#411  -  [R0201]  62.01 64.93 180 bottom
Designator#412  -  [R0201]  70.39 65.69 0 bottom
Designator#413  -  [R0201]  70.39 64.67 0 bottom
Designator#414  -  [R0201]  75.6 64.93 180 bottom
Designator#415  -  [R0201]  1.81 52.1 0 bottom
Designator#416  -  [R0201]  1.81 50.96 0 bottom
Designator#417  -  [R0201]  7.4 51.21 180 bottom
Designator#418  -  [R0201]  15.78 51.97 0 bottom
Designator#419  -  [R0201]  15.78 50.96 0 bottom
Designator#420  -  [R0201]  20.99 51.21 180 bottom
Designator#421  -  [R0201]  29.11 52.1 0 bottom
Designator#422  -  [R0201]  29.11 50.96 0 bottom
Designator#423  -  [R0201]  34.7 51.21 180 bottom
Designator#424  -  [R0201]  43.08 51.97 0 bottom
Designator#425  -  [R0201]  43.08 50.96 0 bottom
Designator#426  -  [R0201]  48.29 51.21 180 bottom
Designator#427  -  [R0201]  56.42 52.1 0 bottom
Designator#428  -  [R0201]  56.42 50.96 0 bottom
Designator#429  -  [R0201]  62.01 51.21 180 bottom
Designator#430  -  [R0201]  70.39 51.97 0 bottom
Designator#431  -  [R0201]  70.39 50.96 0 bottom
Designator#432  -  [R0201]  75.6 51.21 180 bottom
Designator#433  -  [R0201]  1.81 38.38 0 bottom
Designator#434  -  [R0201]  1.81 37.24 0 bottom
Designator#435  -  [R0201]  7.4 37.49 180 bottom
Designator#436  -  [test]  50.42 18.11 270 bottom
Designator#437  -  [qfn-24_l3.0-w3.0-p0.40-bl-ep#2]  4.6 78.01 0 bottom
Designator#438  -  [qfn-24_l3.0-w3.0-p0.40-bl-ep#2]  4.6 9.43 0 bottom
Designator#439  -  [test]  9.4 59.26 270 bottom
Designator#440  -  [vqfn-32_l5.0-w5.0-p0.50-tl-ep3.1]  4.35 31.4 270 bottom
Designator#441  -  [C0201]  64.17 23.02 0 bottom
Designator#442  -  [C0201]  63.78 24.41 180 bottom
Designator#443  -  [C0201]  77.88 23.14 0 bottom
Designator#444  -  [C0201]  77.5 24.41 180 bottom
Designator#445  -  [C0201]  76.36 24.67 0 bottom
Designator#446  -  [C0201]  75.6 23.02 180 bottom
Designator#447  -  [C0201]  70.52 21.11 0 bottom
Designator#448  -  [C0201]  9.56 36.73 0 bottom
Designator#449  -  [C0201]  9.17 38.13 180 bottom
Designator#450  -  [C0201]  7.91 38.38 0 bottom
Designator#451  -  [C0201]  7.4 36.73 180 bottom
Designator#452  -  [C0201]  2.19 34.7 0 bottom